# EasyEDA Pro project Arduino UNO DIY.eprj, board PCB2
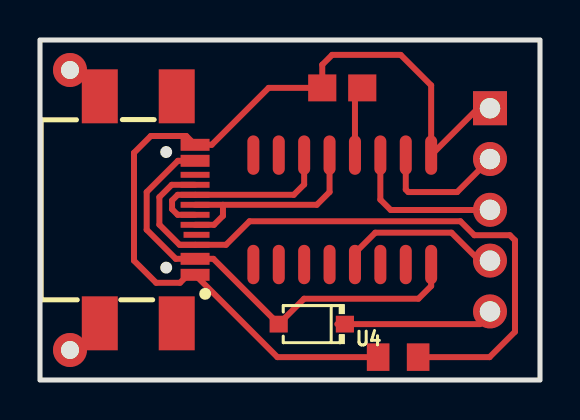
[diagram p10: board, top side]
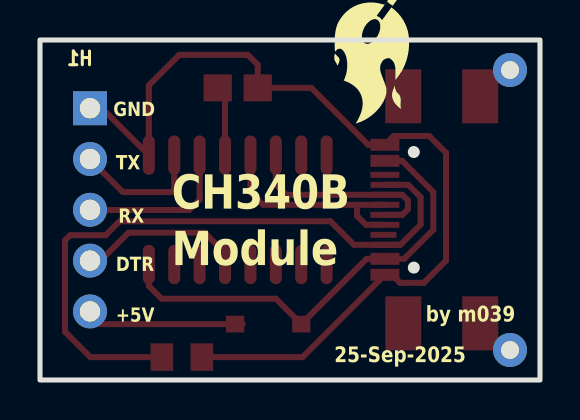
[diagram p11: board, bottom side, seen from below]

Outline 25 x 17 mm; copper layers: Top Layer, Bottom Layer. Coordinates in mm from the lower left corner of the outline.
Outline path: rectangle 0,17 25,0
Stack: Top Layer 0.035mm / Dielectric1 1.51mm FR4 er 4.5 / Bottom Layer 0.035mm

## Design rules (mm)
template: Custom Config
spacing copperThickness1oz (default): track to track 0.2, other pairs 0.152 to 0.4
spacing copperThickness2oz: track to track 0.203, other pairs 0.152 to 0.3
track width copperThickness1oz (default): min 0.127, default 0.3, max 2.54
track width copperThickness2oz: min 0.203, default 0.35, max 2.54
differential pair differentialPair (default): width min 0.127, default 0.254, max 2.54; gap min 0.152, default 0.152
via viaSize (default): diameter min 0.5, default 0.61, max 10; hole min 0.3, default 0.305, max 6.3

## Placement (name value [footprint] x y rotation side)
C7  100nF  [C0805]  15.11 14.61 0 top
H1  -  [HDR-TH_5P-P2.54-V-F]  22.5 8.51 270 top
NOREF  -  [Pad_e1746]  1.5 1.5 0 top
NOREF#2  -  [Pad_e1745]  1.5 15.5 0 top
R1  5.1kOhm  [R0805]  17.91 1.14 0 top
U2  CH340B  [SOIC-16_L9.9-W3.9-P1.27-LS6.0-BL]  15.11 8.51 180 top
U3  PTP403-G0326-7R  [USB_16PIN_FLAT]  5.21 8.51 270 top
U4  1N5819/SOD-123  [SOD-123_L2.7-W1.7-LS3.8-RD]  13.59 2.79 180 top

## Footprints (pads in the part's own frame, mm; a bottom-side part is the same pattern mirrored in y, then rotated)
C0805
  rect 1.41x1.35 smd: 1(-1,0) 2(1,0)
HDR-TH_5P-P2.54-V-F
  rect 1.7x1.7 hole 1.02x0.9: 1(-5.08,0)
  round 1.7 hole 1.02x0.9: 2(-2.54,0) 3(0,0) 4(2.54,0) 5(5.08,0)
Pad_e1745
  round 1.7 hole 0.9: 1(0,0)
Pad_e1746
  round 1.7 hole 0.9: 2(0,0)
R0805
  rect 1.133x1.377 smd: 1(-1,0) 2(1,0)
SOD-123_L2.7-W1.7-LS3.8-RD
  rect 0.91x0.84 smd: 1(-1.655,0) 2(1.655,0)
SOIC-16_L9.9-W3.9-P1.27-LS6.0-BL
  oval 0.602x1.971 smd: 1(-4.445,-2.736) 2(-3.175,-2.736) 3(-1.905,-2.736) 4(-0.635,-2.736) 5(0.635,-2.736) 6(1.905,-2.736) 7(3.175,-2.736) 8(4.445,-2.736) 9(4.445,2.736) 10(3.175,2.736) 11(1.905,2.736) 12(0.635,2.736) 13(-0.635,2.736) 14(-1.905,2.736) 15(-3.175,2.736) 16(-4.445,2.736)
USB_16PIN_FLAT
  rect 0.3x1.45 smd: A5(-1.25,2.547) A6(-0.25,2.547) A7(0.25,2.547) B5(1.75,2.547) B6(0.75,2.547) B7(-0.75,2.547) B8(-1.75,2.547)
  rect 0.3x1.3 smd: A8(1.25,2.62)
  rect 0.6x1.45 smd: B1(3.25,2.547) B4(2.45,2.547) B9(-2.45,2.547) B12(-3.25,2.547)

## Nets
As in the schematic.

Pads without a net: NOREF 2; NOREF#2 1; U2 7 8 9 10 11 12 14 15; U3 A8 B8

## Routing (per net, layer and track width the routed paths; a pad name or vN(x,y) marks a point on that pad's centre or on a via; arc(x,y) is an arc through that point)
+5V: length 23
  Top Layer w0.3: U2.16 19.56,4.7 18.92,4.06 13.2,4.06 U4.2 8.67,6.06 U3.B4 6.79,6.06 5.33,7.51 5.33,9.4 6.9,10.96 U3.B9
GND: length 45.3
  Top Layer w0.3: 21.89,13.58 U2.1 19.56,14.73 18.03,16.26 14.6,16.26 14.11,15.76 C7.1 11.43,14.61 8.58,11.76 U3.B12 7.31,12.2 5.54,12.2 4.7,11.36 4.7,5.97 5.81,4.86 7,4.86 7.3,5.16 7.66,5.16 U3.B1 11.87,1.14 R1.1
D+: length 11
  Top Layer w0.3: U3.A6 9.15,8.76 ; 9.15,8.76 13.84,8.76 14.48,9.4 U2.5 ; 9.15,8.76 9.15,8.21 8.7,7.76 U3.B6
D-: length 10.1
  Top Layer w0.3: U2.6 13.21,9.78 12.69,9.26 U3.B7 6.88,9.26 6.6,8.98 6.6,8.54 6.88,8.26 U3.A7
DTR: length 7.8
  Top Layer w0.3: 21.98,5.96 20.57,7.37 16.76,7.37 15.75,6.35 U2.13
RX: length 7.9
  Top Layer w0.3: U2.3 17.02,9.02 17.53,8.5 22.5,8.5
TX: length 6.7
  Top Layer w0.3: 22.5,11.04 20.86,9.4 18.41,9.4 18.29,9.53 U2.2
$1N284: length 3.5
  Top Layer w0.3: C7.2 15.75,14.24 U2.4
$1N639: length 32.4
  Top Layer w0.3: U3.A5 6.58,9.76 5.97,9.14 5.97,7.77 6.98,6.76 U3.B5 9.3,6.76 10.48,7.94 21.02,7.94 21.72,7.24 23.5,7.24 23.75,6.98 23.75,2.41 22.48,1.14 R1.2
$1N2711: length 8
  Top Layer w0.3: H1.5 22.41,3.34 22.41,3.21 21.99,2.79 14.86,2.79

## Text on the board
Bottom Silkscreen Layer: by m039 | 25-Sep-2025 | CH340B / Module | RX | TX | DTR | +5V | GND
